# EasyEDA Pro project Arduino UNO DIY.eprj, board PCB1
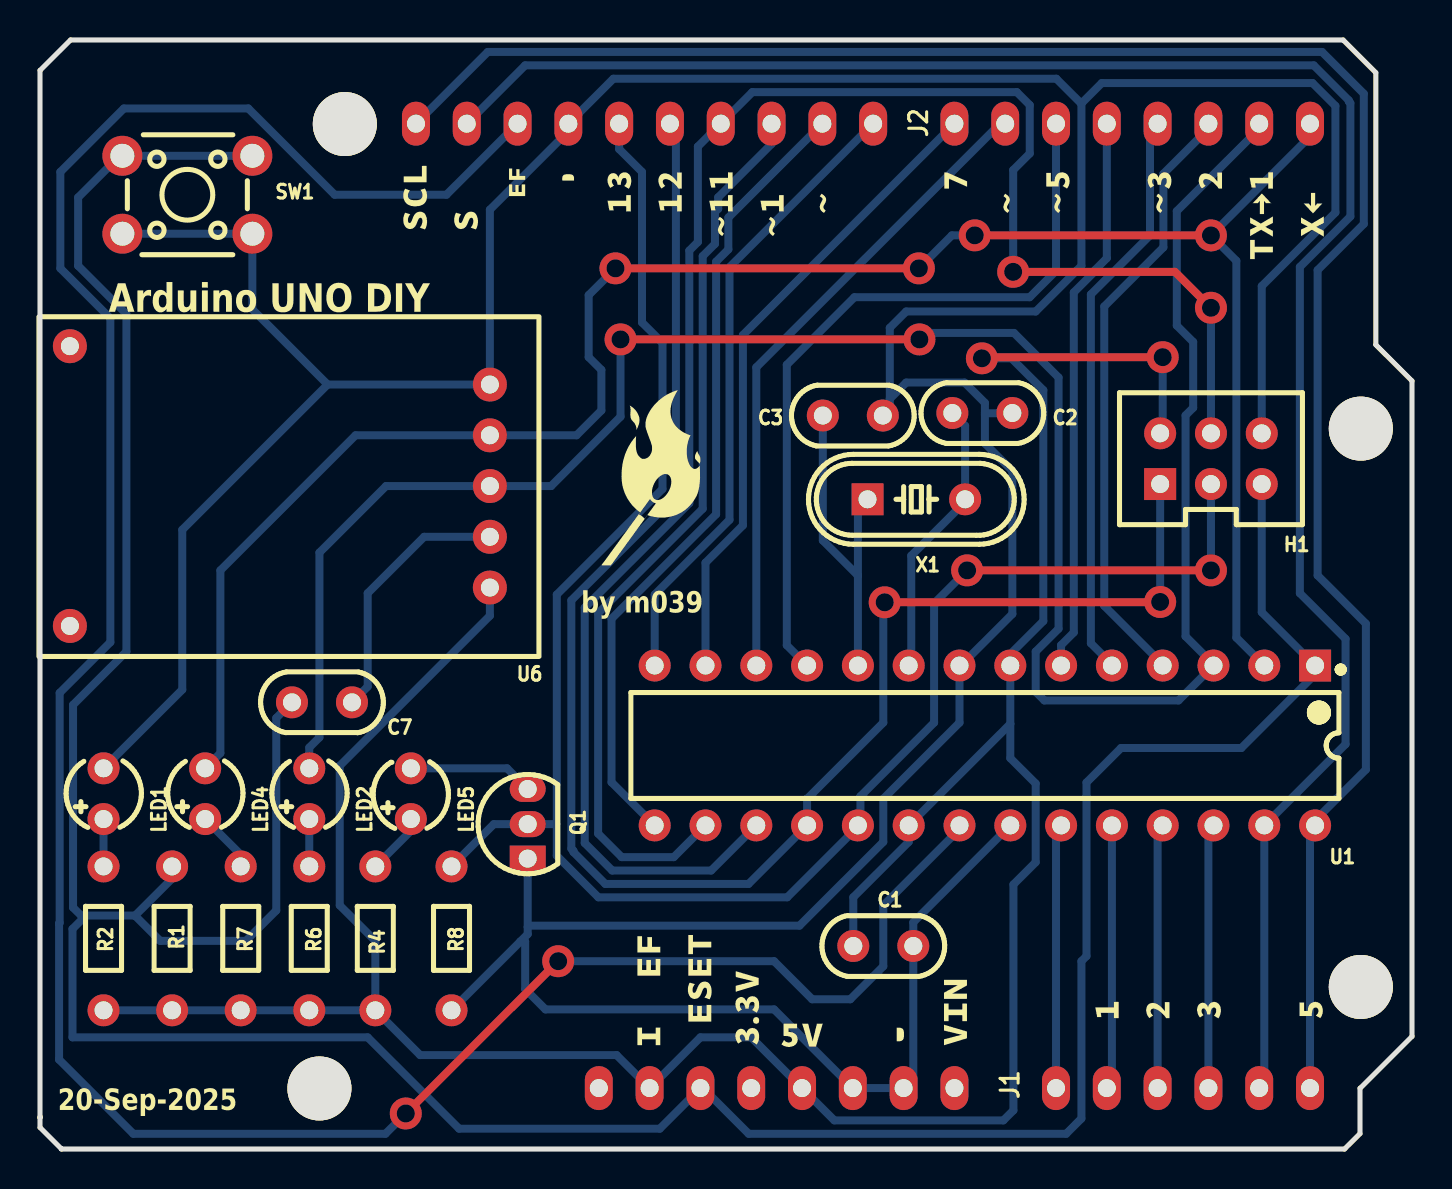
[diagram p8: board, top side]
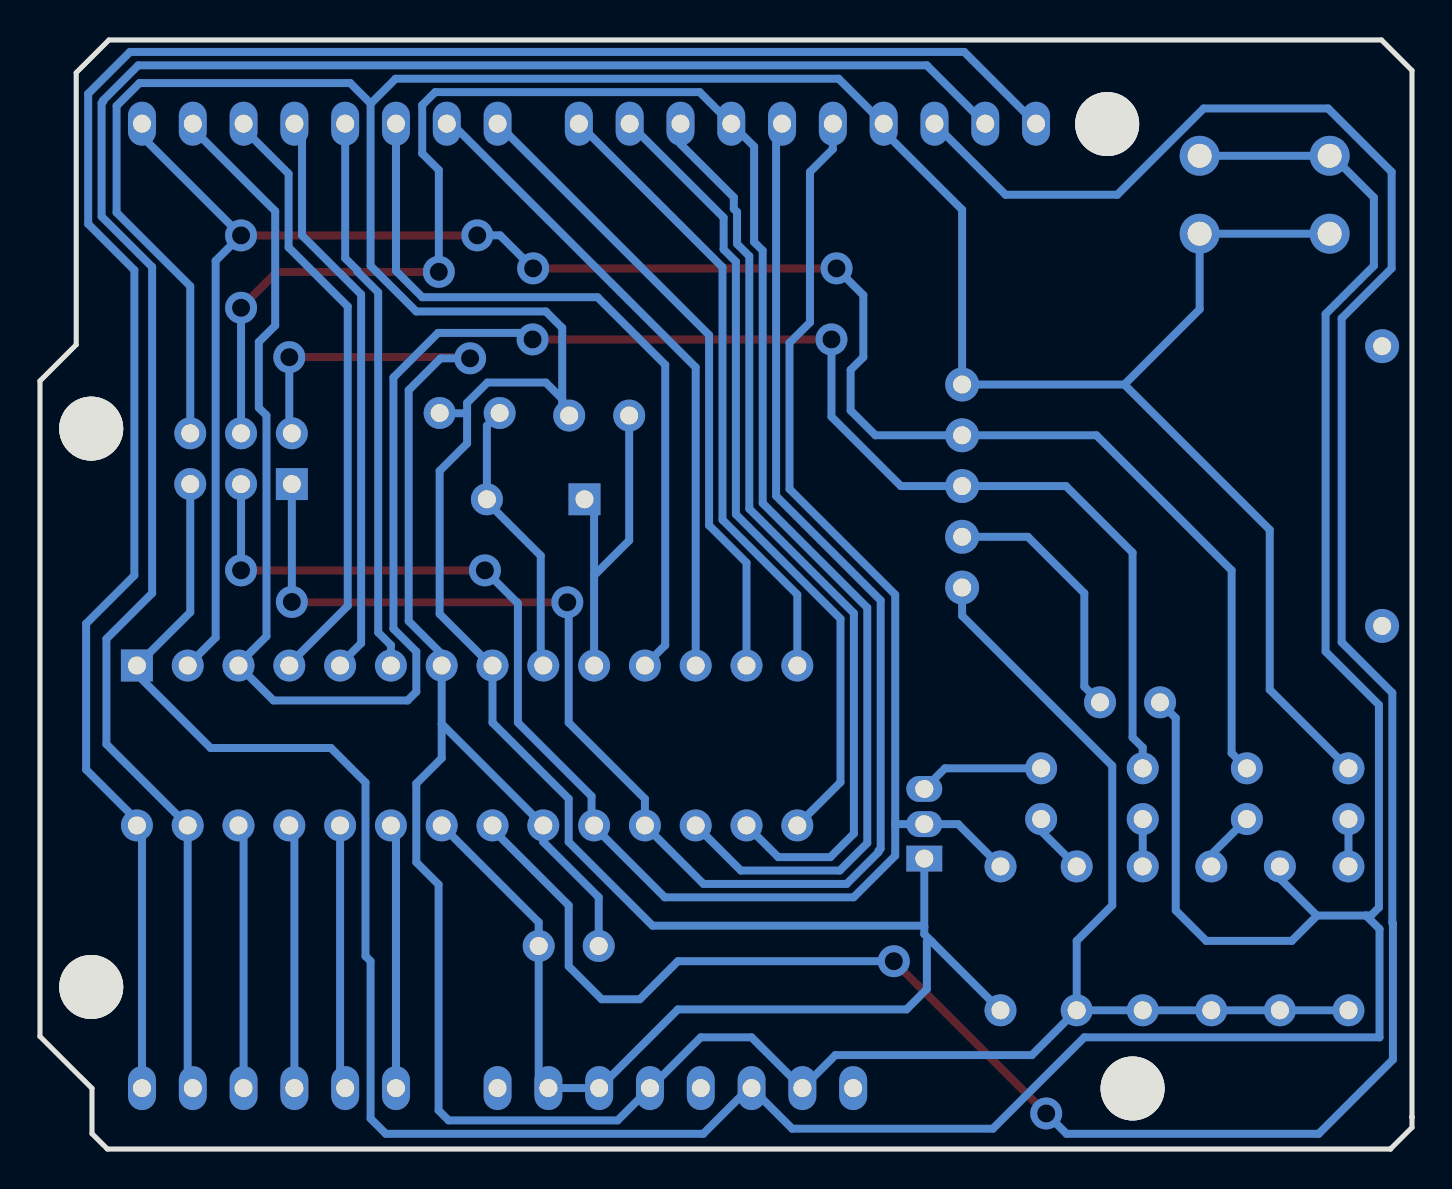
[diagram p9: board, bottom side, seen from below]

Outline 68.6 x 55.5 mm; copper layers: Top Layer, Bottom Layer. Coordinates in mm from the lower left corner of the outline.
Outline path: 0,1.62 0,1.57 0,53.97 1.53,55.5 65.15,55.5 66.79,53.86 66.79,40.25 68.6,38.44 68.6,5.64 66,3.04 66,0.77 65.23,0 1.07,0 1.07,0.01 0,1.08 0,1.62
Stack: Top Layer 0.035mm / Dielectric1 1.51mm FR4 er 4.5 / Bottom Layer 0.035mm

## Design rules (mm)
template: Custom Config
spacing copperThickness1oz (default): track to track 0.27, other pairs 0.152 to 0.4
spacing copperThickness2oz: track to track 0.203, other pairs 0.152 to 0.3
track width copperThickness1oz (default): min 0.127, default 0.4, max 2.54
track width copperThickness2oz: min 0.203, default 0.254, max 2.54
differential pair differentialPair (default): width min 0.127, default 0.254, max 2.54; gap min 0.152, default 0.152
via viaSize (default): diameter min 0.5, default 0.61, max 10; hole min 0.3, default 0.305, max 6.3

## Placement (name value [footprint] x y rotation side)
C1  100nF  [CAP-TH_L6.0-W3.0-P3.00-D0.5]  42.17 10.16 180 top
C2  22pF  [CAP-TH_L6.0-W3.0-P3.00-D0.5]  47.12 36.83 180 top
C3  22pF  [CAP-TH_L6.0-W3.0-P3.00-D0.5]  40.64 36.7 180 top
C7  100nF  [CAP-TH_L6.0-W3.0-P3.00-D0.5]  14.1 22.35 0 top
H1  -  [AVR ISP 6P]  58.55 34.55 0 top
J1  -  [Arduino Uno Bottom Header]  45.85 2.92 0 top
J2  -  [Arduino Uno Top Header]  41.66 51.31 0 top
LED1  LED P  [LED-TH_BD3.0-P2.54-FD]  3.18 17.78 90 top
LED2  LED RX  [LED-TH_BD3.0-P2.54-FD]  13.46 17.78 90 top
LED4  LED TX  [LED-TH_BD3.0-P2.54-FD]  8.26 17.78 90 top
LED5  LED L  [LED-TH_BD3.8-P2.54-FD_BLUE]  18.54 17.78 90 top
NOREF  -  [Pad_ie906]  13.97 3.03 0 top
NOREF#2  -  [Pad_ie907]  15.24 51.29 0 top
NOREF#3  -  [Pad_ie898]  66.04 36.05 0 top
NOREF#4  -  [Pad_ie899]  66.04 8.11 0 top
Q1  2N7000  [TO-92-3_L4.9-W3.7-P1.27-L]  24.39 16.26 90 top
R1  10kΩ  [RES-TH_BD1.8-L3.2-P7.20-D0.4]  6.61 10.54 270 top
R2  1kΩ  [RES-TH_BD1.8-L3.2-P7.20-D0.4]  3.18 10.54 270 top
R4  1kΩ  [RES-TH_BD1.8-L3.2-P7.20-D0.4]  16.77 10.54 90 top
R6  1kΩ  [RES-TH_BD1.8-L3.2-P7.20-D0.4]  13.46 10.54 90 top
R7  1kΩ  [RES-TH_BD1.8-L3.2-P7.20-D0.4]  10.03 10.54 90 top
R8  1MΩ  [RES-TH_BD1.8-L3.2-P7.20-D0.4]  20.58 10.54 90 top
SW1  -  [KEY-TH_4P-L6.0-W6.0-P3.90-LS6.5]  7.37 47.75 180 top
U1  ATMEGA328P-PU  [DIP-28_L34.6-W7.3-P2.54-LS10.2-BL]  47.25 20.19 180 top
U6  -  [CH340B Module]  -0.13 24.64 0 top
X1  16MHz  [HC-49US_L11.5-W4.5-P4.88]  43.82 32.51 0 top

## Footprints (pads in the part's own frame, mm; a bottom-side part is the same pattern mirrored in y, then rotated)
Arduino Uno Bottom Header
  oval 1.4x2.2 hole 0.9: 1(-17.907,0.127) 2(-15.367,0.127) 3(-12.827,0.127) 4(-10.287,0.127) 5(-7.747,0.127) 6(-5.207,0.127) 7(-2.667,0.127) 8(-0.127,0.127) 9(4.953,0.127) 10(7.493,0.127) 11(10.033,0.127) 12(12.573,0.127) 13(15.113,0.127) 14(17.653,0.127)
Arduino Uno Top Header
  oval 1.4x2.2 hole 0.9: 1(21.844,0) 2(19.304,0) 3(16.764,0) 4(14.224,0) 5(11.684,0) 6(9.144,0) 7(6.604,0) 8(4.064,0) 9(0,0) 10(-2.54,0) 11(-5.08,0) 12(-7.62,0) 13(-10.16,0) 14(-12.7,0) 15(-15.24,0) 16(-17.78,0) 17(-20.32,0) 18(-22.86,0)
AVR ISP 6P
  rect 1.6x1.6 hole 0.9: 1(-2.54,-1.27)
  round 1.6 hole 0.9: 2(-2.54,1.27) 3(0,-1.27) 4(0,1.27) 5(2.54,-1.27) 6(2.54,1.27)
CAP-TH_L6.0-W3.0-P3.00-D0.5
  round 1.6 hole 0.9: 1(-1.5,0) 2(1.5,0)
CH340B Module
  round 1.7 hole 0.9: 1(22.619,13.617) 2(22.619,11.077) 3(22.619,8.537) 4(22.619,5.997) 5(22.619,3.457) 6(1.619,15.537) 7(1.619,1.537)
DIP-28_L34.6-W7.3-P2.54-LS10.2-BL
  rect 1.6x1.6 hole 0.9: 1(-16.51,-4)
  round 1.6 hole 0.9: 2(-13.97,-4) 3(-11.43,-4) 4(-8.89,-4) 5(-6.35,-4) 6(-3.81,-4) 7(-1.27,-4) 8(1.27,-4) 9(3.81,-4) 10(6.35,-4) 11(8.89,-4) 12(11.43,-4) 13(13.97,-4) 14(16.51,-4) 15(16.51,4) 16(13.97,4) 17(11.43,4) 18(8.89,4) 19(6.35,4) 20(3.81,4) 21(1.27,4) 22(-1.27,4) 23(-3.81,4) 24(-6.35,4) 25(-8.89,4) 26(-11.43,4) 27(-13.97,4) 28(-16.51,4)
HC-49US_L11.5-W4.5-P4.88
  rect 1.6x1.6 hole 0.9: 1(-2.44,0)
  round 1.6 hole 0.9: 2(2.44,0)
KEY-TH_4P-L6.0-W6.0-P3.90-LS6.5
  round 2 hole 1.2x0.9: 1(-3.25,1.95) 2(3.25,1.95) 3(-3.25,-1.95) 4(3.25,-1.95)
LED-TH_BD3.0-P2.54-FD
  round 1.6 hole 0.9: 1(-1.27,0) 2(1.27,0)
LED-TH_BD3.8-P2.54-FD_BLUE
  round 1.6 hole 0.9: 1(-1.27,0) 2(1.27,0)
Pad_ie898
  round 3.2 hole 3.2: (0,0)
Pad_ie899
  round 3.2 hole 3.2: (0,0)
Pad_ie906
  round 3.2 hole 3.2: (0,0)
Pad_ie907
  round 3.2 hole 3.2: (0,0)
RES-TH_BD1.8-L3.2-P7.20-D0.4
  round 1.6 hole 0.9: 1(-3.6,0) 2(3.6,0)
TO-92-3_L4.9-W3.7-P1.27-L
  rect 1.3x1.8 hole 0.9: 1(-1.724,0)
  oval 1.3x1.8 hole 0.9: 2(0,0) 3(1.761,0)

## Nets
As in the schematic.

Pads without a net: J1 1 8; U6 6 7

## Via types
v1: diameter 1.6, hole 0.9, Top Layer to Bottom Layer, 16 vias

## Routing (per net, layer and track width the routed paths; a pad name or vN(x,y) marks a point on that pad's centre or on a via; arc(x,y) is an arc through that point)
+5V: length 143.8
  Top Layer w0.4: v1(47.1,39.57) 47.15,39.63 v1(56.14,39.63)
  Bottom Layer w0.4: R4.1 16.77,10.42 14.99,12.19 14.99,19.18 22.49,26.69 U6.5 ; R4.1 R6.1 R7.1 R1.2 R2.2 ; R4.1 19.01,4.7 28.83,4.7 J1.2 33.02,5.59 35.56,5.59 J1.5 39.72,1.43 48.17,1.43 48.67,1.94 48.67,13.24 49.79,14.35 49.79,18.29 48.52,19.56 48.52,21.27 ; H1.2 56.14,35.94 v1(56.14,39.63) ; v1(47.1,39.57) 48.57,39.57 50.17,37.97 50.17,26.42 48.52,24.77 U1.7 48.52,21.27 ; 48.52,21.27 U1.20 43.44,15.37 40.67,12.6 C1.2
GND: length 244.2
  Bottom Layer w0.4: 14.38,38.26 7.11,30.99 7.11,22.99 LED1.2 ; 14.38,38.26 U6.1 22.49,47.01 26.42,50.93 J2.15 28.67,53.56 50.82,53.56 52.06,52.32 ; 14.38,38.26 10.62,42.02 SW1.1 SW1.2 ; Q1.1 24.39,11.11 ; 24.39,11.11 24.45,11.18 37.97,11.18 42.17,15.37 42.17,17.53 45.98,21.34 U1.8 46.04,24.19 48.62,26.77 48.62,33.93 47.25,35.31 47.25,36.76 47.32,36.83 ; 24.39,11.11 24.39,10.75 24.02,10.38 ; 47.32,36.83 47.33,36.82 48.61,36.82 C2.1 ; 47.32,36.83 47.25,36.83 47.25,37.34 46.23,38.36 43.31,38.36 42.49,37.54 ; 24.02,10.38 R8.1 ; 24.02,10.38 24.26,10.38 24.26,8 25.27,6.99 36.7,6.99 J1.6 J1.7 43.67,3.53 C1.1 43.67,11.34 U1.22 ; H1.6 61.09,43.18 64.77,46.86 64.77,52.2 63.63,53.34 53.09,53.34 52.06,52.32 ; 42.49,37.54 42.49,41.09 43.31,41.91 49.79,41.91 52.07,44.2 52.07,52.31 52.06,52.32 ; 42.49,37.54 42.49,37.05 C3.1
AD0: length 13.3
  Bottom Layer w0.4: U1.23 50.8,15.94 J1.9
AD1: length 13.3
  Bottom Layer w0.4: J1.10 53.6,3.3 U1.24
AD2: length 13.3
  Bottom Layer w0.4: U1.25 55.88,15.94 J1.11
AD3: length 13.3
  Bottom Layer w0.4: J1.12 58.42,15.94 U1.26
AD4/SDA: length 99.3
  Bottom Layer w0.4: J2.17 24.26,54.23 63.69,54.23 65.44,52.48 65.44,52.42 65.52,52.34 65.52,46.67 62.99,44.14 62.99,27.81 65.28,25.53 65.28,20.26 U1.27 61.22,3.3 J1.13
AD5/SCL: length 102.6
  Bottom Layer w0.4: J1.14 63.5,15.94 U1.28 63.76,16.45 66.3,18.99 66.3,26.29 63.88,28.7 63.88,43.98 66.19,46.29 66.19,52.81 64.1,54.9 22.39,54.9 J2.18
AREF: length 130.4
  Top Layer w0.4: v1(25.91,9.4) v1(18.29,1.78)
  Bottom Layer w0.4: v1(25.91,9.4) 36.7,9.4 38.61,7.49 40.51,7.49 42.17,9.15 42.17,12.19 45.98,16 U1.21 ; v1(18.29,1.78) 17.27,0.76 4.66,0.76 0.95,4.48 0.95,11.29 0.98,11.32 0.98,22.83 3.52,25.36 3.52,41.57 1.02,44.07 1.02,48.9 4.19,52.07 10.42,52.07 14.73,47.75 20.32,47.75 J2.16
DTR: length 13.1
  Bottom Layer w0.4: U6.4 19.21,30.64 16.38,27.81 16.38,23.14 C7.2
IO0: length 101.2
  Top Layer w0.4: v1(43.94,44.07) v1(28.77,44.07) ; v1(58.55,45.72) 58.55,45.72 v1(46.74,45.72)
  Bottom Layer w0.4: v1(28.77,44.07) 27.43,42.73 27.43,39.63 28.07,38.99 28.07,36.96 26.83,35.72 U6.2 15.78,35.72 9.02,28.96 9.02,19.81 LED4.2 ; v1(43.94,44.07) 45.59,45.72 v1(46.74,45.72) ; J2.1 63.5,50.67 v1(58.55,45.72) 59.82,44.45 59.82,25.59 U1.2
IO1: length 111.6
  Top Layer w0.4: v1(29.03,40.51) v1(43.97,40.51)
  Bottom Layer w0.4: v1(29.03,40.51) 29.03,36.65 25.56,33.18 U6.3 17.3,33.18 13.97,29.85 13.97,20.6 13.46,20.09 LED2.2 ; v1(43.97,40.51) 44.29,40.84 48.7,40.84 50.93,38.61 50.93,26.04 49.79,24.89 49.79,22.88 50.22,22.45 56.93,22.45 U1.3 58.68,24.26 57.28,25.66 57.28,36.71 57.66,37.09 57.66,40.39 56.84,41.21 56.84,46.93 60.96,51.06 J2.2
IO2: length 30.5
  Bottom Layer w0.4: J2.3 58.42,51.06 56.17,48.8 56.17,45.12 53.21,42.17 53.21,27.18 56.14,24.26 U1.4
IO3: length 28.9
  Bottom Layer w0.4: U1.5 53.6,24.26 52.54,25.31 52.54,42.77 55.5,45.72 55.5,50.93 J2.4
IO4: length 28.1
  Bottom Layer w0.4: U1.6 51.06,25.22 51.69,25.85 51.69,42.87 52.74,43.92 52.74,43.98 53.34,44.58 J2.5
IO5: length 38.2
  Bottom Layer w0.4: J2.6 50.8,43.94 49.48,42.63 40.72,42.63 37.34,39.24 37.34,25.21 U1.11
IO6: length 32.4
  Bottom Layer w0.4: J2.7 48.01,51.31 35.82,39.12 U1.12
IO7: length 32.3
  Bottom Layer w0.4: U1.13 33.28,29.34 35.15,31.21 35.15,40.73 J2.8
IO8: length 31.6
  Bottom Layer w0.4: U1.14 30.74,27.75 34.48,31.49 34.48,44.13 J2.9
IO9: length 40.4
  Bottom Layer w0.4: U1.15 28.58,18.35 28.58,26.53 33.81,31.76 33.81,44.41 34.42,45.02 34.42,46.61 J2.10
MISO: length 84.8
  Top Layer w0.4: v1(42.24,27.36) 55.99,27.36 v1(56.01,27.38)
  Bottom Layer w0.4: J2.13 31.8,51.01 31.8,32.68 26.57,27.46 26.57,15.03 26.67,14.93 26.67,14.86 28.27,13.27 35.43,13.27 U1.18 38.36,17.53 42.17,21.34 42.17,27.29 v1(42.24,27.36) ; H1.1 v1(56.01,27.38)
MOSI: length 90.9
  Top Layer w0.4: v1(58.55,42.1) 56.75,43.9 v1(48.66,43.9)
  Bottom Layer w0.4: U1.17 33.56,13.94 28.61,13.94 27.24,15.31 27.24,27.09 32.47,32.32 32.47,44.96 32.89,45.39 32.89,50.17 J2.12 35.62,52.89 48.84,52.89 49.49,52.24 49.49,49.82 48.66,48.99 v1(48.66,43.9) ; v1(58.55,42.1) H1.4
RESET: length 174.7
  Bottom Layer w0.4: 4.76,11.69 6.61,13.53 R1.1 ; 4.76,11.69 4.76,11.67 6.01,10.42 10.29,10.42 11.81,11.94 11.81,21.57 C7.1 ; 4.76,11.69 2.3,11.69 ; 2.3,11.69 1.62,11.01 1.62,5.59 16.38,5.59 20.96,1.02 30.99,1.02 J1.3 33.15,3.05 35.43,0.76 51.31,0.76 52.07,1.53 52.07,9.4 52.33,9.65 52.33,18.34 54.05,20.07 60.07,20.07 63.76,23.76 U1.1 61.09,26.86 H1.5 ; 2.3,11.69 2.05,11.69 1.65,12.09 1.65,22.23 4.32,24.89 4.32,41.78 1.91,44.2 1.91,47.62 3.99,49.7 SW1.4 SW1.3
SCK: length 94.8
  Top Layer w0.4: v1(58.55,28.96) v1(46.36,28.96)
  Bottom Layer w0.4: 25.84,16.26 25.84,14.68 27.92,12.6 37.36,12.6 40.9,16.13 U1.19 41.02,16.32 41.02,17.65 44.71,21.34 44.71,27.31 v1(46.36,28.96) ; 25.84,16.26 Q1.2 22.69,16.26 R8.2 ; 25.84,16.26 25.84,27.74 31.13,33.03 31.13,40.34 30.1,41.36 30.1,48.9 28.96,50.04 J2.14 ; H1.3 v1(58.55,28.96)
SS: length 45.6
  Bottom Layer w0.4: U1.16 31.69,14.61 29.08,14.61 27.91,15.78 27.91,26.81 33.14,32.04 33.14,44.68 33.75,45.3 33.75,46.89 33.91,47.05 33.91,47.63 36.58,50.29 J2.11
$1N623: length 14.1
  Bottom Layer w0.4: C2.2 46.26,36.19 X1.2 ; U1.9 43.56,24.32 43.56,29.69 46.38,32.51
$1N638: length 17.3
  Bottom Layer w0.4: 40.9,28.7 40.9,32.03 X1.1 ; 40.9,28.7 39.14,30.45 C3.2 ; 40.9,28.7 U1.10
$1N1307: length 2.4
  Bottom Layer w0.4: LED1.1 R2.1
$1N3002: length 2.4
  Bottom Layer w0.4: LED2.1 R6.2
$1N3123: length 3.1
  Bottom Layer w0.4: LED4.1 10.03,14.73 R7.2
$1N3829: length 3.1
  Bottom Layer w0.4: R4.2 18.54,15.92 LED5.1
$1N3875: length 6.3
  Bottom Layer w0.4: 24.39,18.02 23.35,19.05 LED5.2

## Text on the board
Top Silkscreen Layer: 20-Sep-2025 | by m039 | Arduino UNO DIY
